# EasyEDA Pro project Project_first.eprj, schematic Schematic9 (continued)
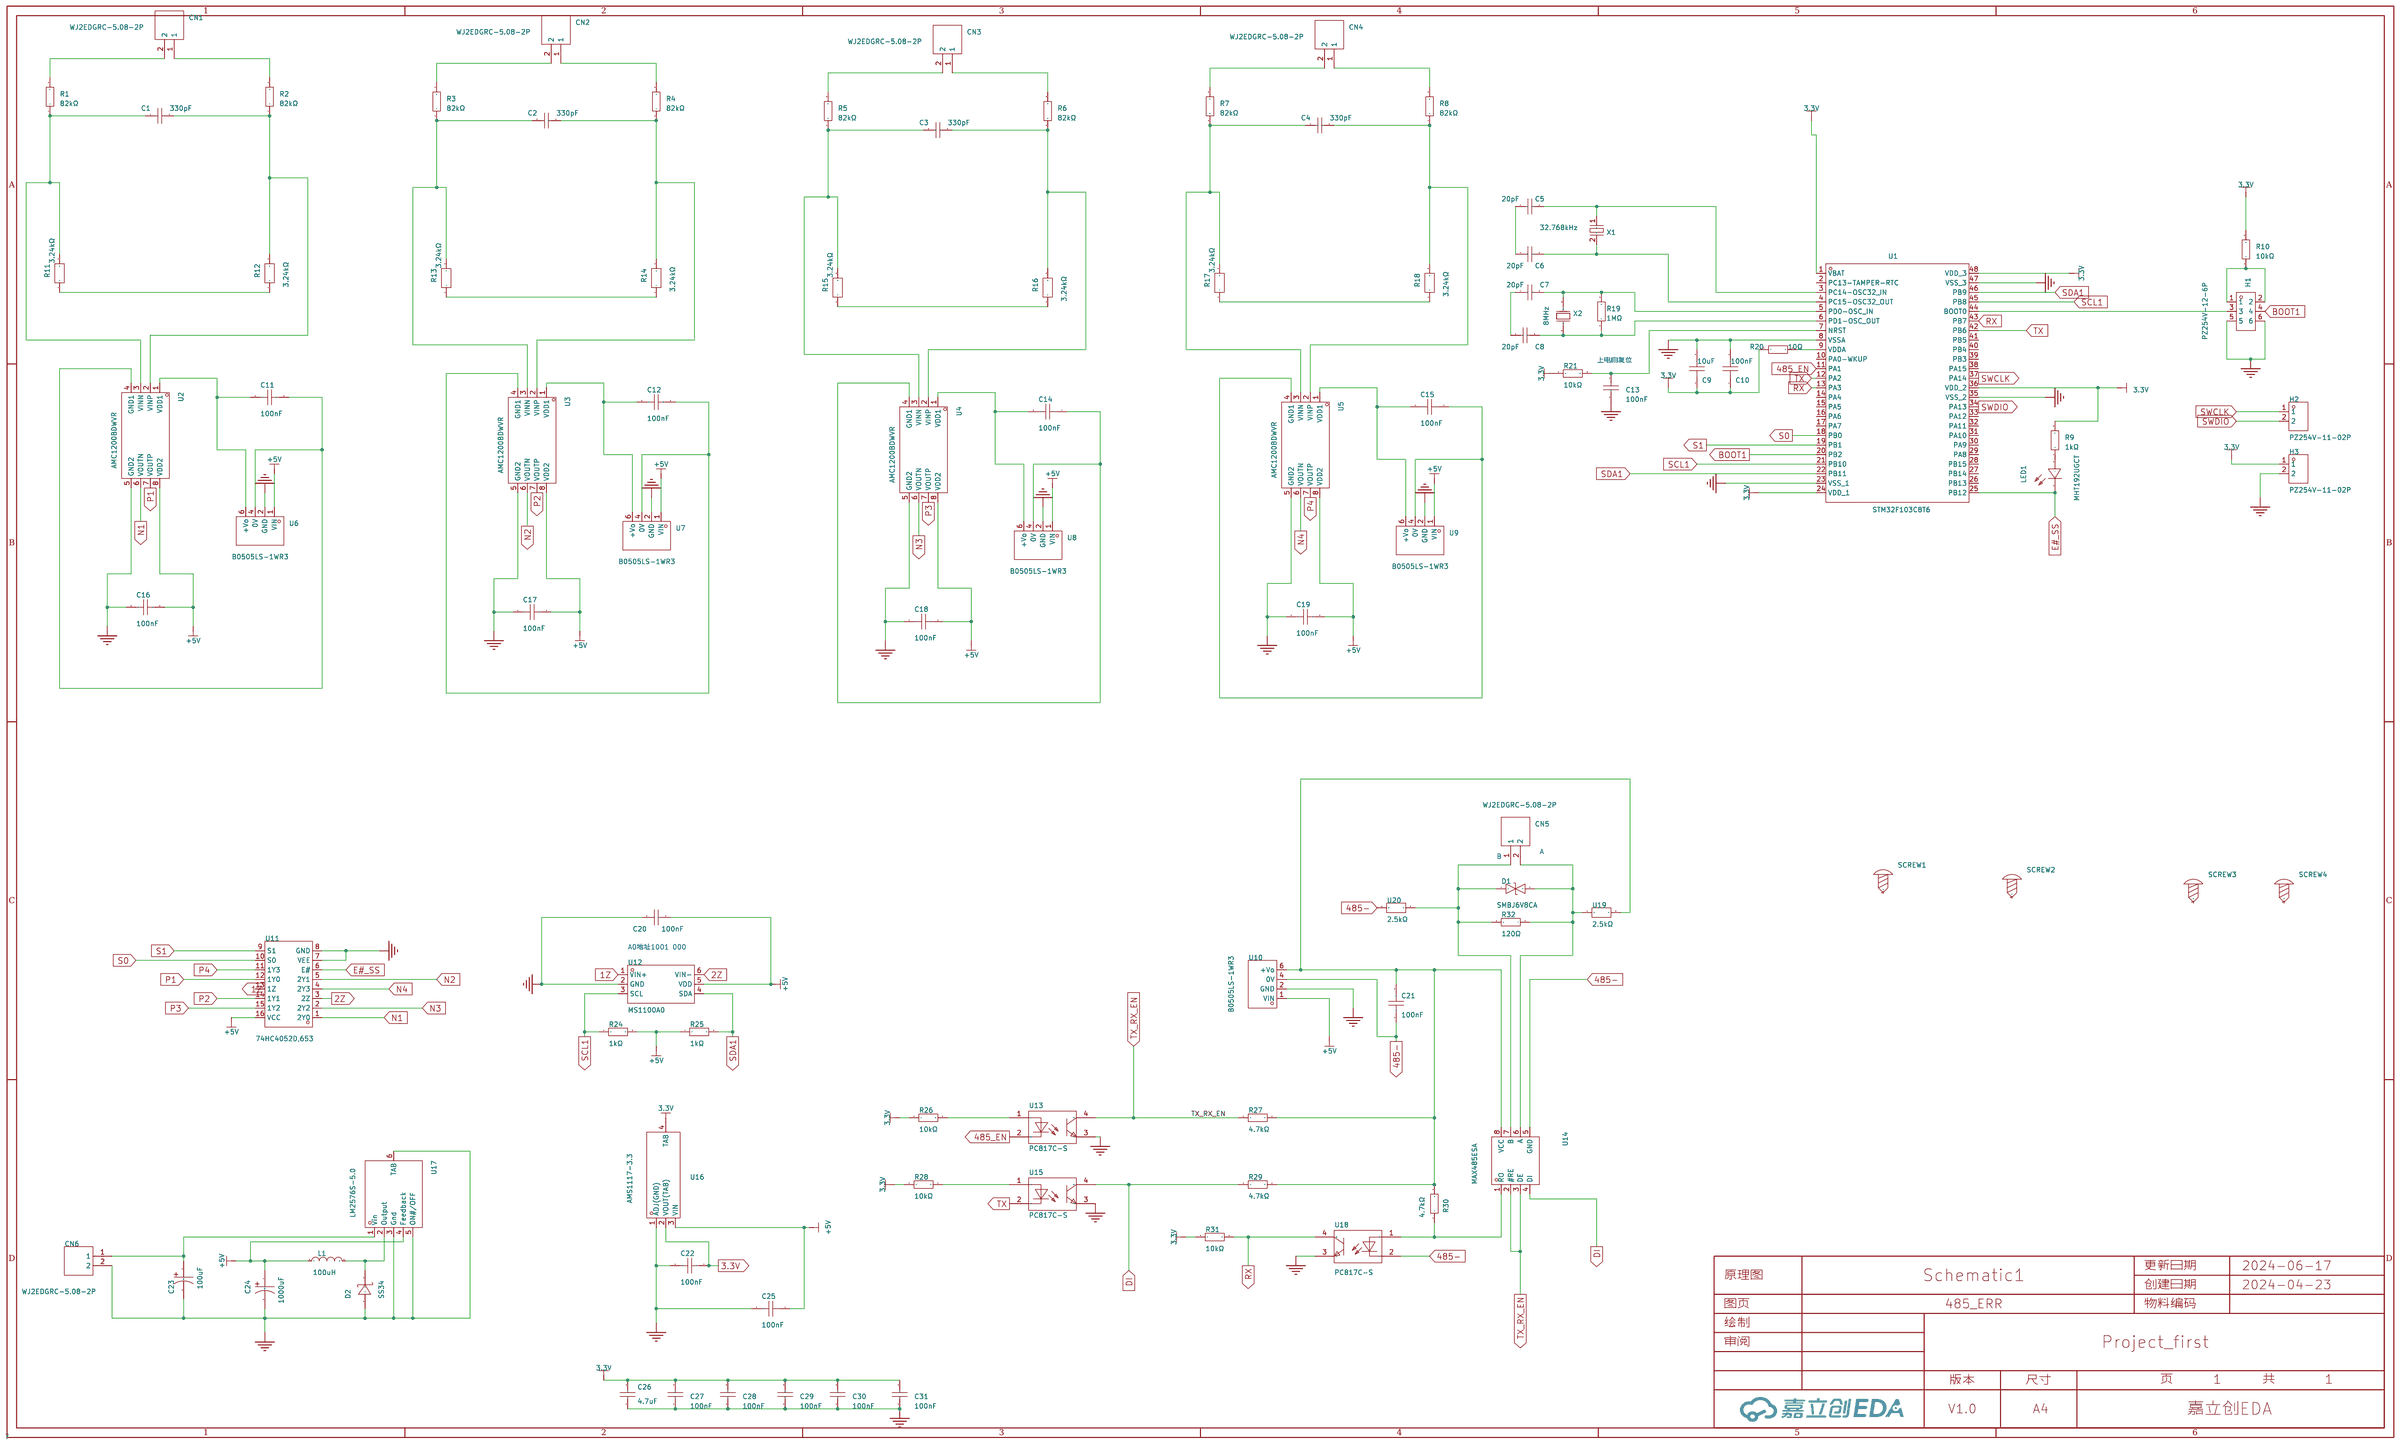
[diagram p0: schematic sheet]
## Parts (continued)
RST  PZ254V-11-02P  [HDR-TH_2P-P2.54-V-M]
SCREW1  -  [M2螺丝]
SCREW2  -  [M2螺丝]
SCREW3  -  [M2螺丝]
SCREW4  -  [M2螺丝]
SPI1  2.54-1*4P母  [HDR-TH_4P-P2.54-V-F]
STM1  STM32F103C8T6  [LQFP-48_L7.0-W7.0-P0.50-LS9.0-BL]
USART1  PZ254V-11-02P  [HDR-TH_2P-P2.54-V-M]
sheet sp232
C35  100nF  [C0603]
C36  100nF  [C0603]
C37  100nF  [C0603]
C38  100nF  [C0603]
C39  100nF  [C0603]
H1  PZ254V-12-6P  [HDR-TH_6P-P2.54-V-M-R2-C3-S2.54]
R77  120Ω  [R0603]
RS2  SP3232EEN-L/TR  [SOIC-16_L9.9-W3.9-P1.27-LS6.0-BL]
RS3  WJ500V-5.08-2P  [CONN-TH_2P-P5.00_WJ500V-5.08-2P]
sheet w5500
C10  1nF  [CAP-TH_L5.5-W4.0-P5.00-D0.5]
C11  20pF  [C0805]
C12  1nF  [CAP-TH_L5.5-W4.0-P5.00-D0.5]
C13  4.7uF  [C0603]
C14  10nF  [C0603]
C15  20pF  [C0805]
C16  22nF  [C0603]
C17  6.8nF  [C0603]
C18  6.8nF  [C0603]
C19  10nF  [C0603]
L1  HR641680E  [XFMR-SMD_HR641680E]
R7  10kΩ  [R0603]
R8  10kΩ  [R0603]
R9  12.4kΩ  [R0603]
R10  10kΩ  [R0603]
R11  10kΩ  [R0603]
R12  10kΩ  [R0603]
R13  10kΩ  [R0603]
R14  75Ω  [R0603]
R15  75Ω  [R0603]
R16  75Ω  [R0603]
R17  75Ω  [R0603]
R18  10Ω  [R0603]
R19  330Ω  [R0603]
R20  49.9Ω  [R0603]
R21  49.9Ω  [R0603]
R22  330Ω  [R0603]
R23  82Ω  [R0603]
R24  82Ω  [R0603]
RJ1  R-RJ45R08P-C000  [RJ45-TH_R-RJ45R08P-C000]
U1  FCM1608KF-201T08  [L0603]
U2  W5500  [LQFP-48_L7.0-W7.0-P0.50-LS9.0-BL]
X1  25MHz  [HC-49US_L11.5-W4.5-P4.88]
sheet 差分电压
C20  10uF  [C0603]
C21  0.1uF  [C0603]
C22  10uF  [C0603]
C23  0.1uF  [C0603]
C24  10uF  [C0603]
C25  0.1uF  [C0603]
P1  WJ500V-5.08-2P  [CONN-TH_2P-P5.00_WJ500V-5.08-2P]
P2  WJ500V-5.08-2P  [CONN-TH_2P-P5.00_WJ500V-5.08-2P]
P3  WJ500V-5.08-2P  [CONN-TH_2P-P5.00_WJ500V-5.08-2P]
P4  WJ500V-5.08-2P  [CONN-TH_2P-P5.00_WJ500V-5.08-2P]
P5  WJ500V-5.08-2P  [CONN-TH_2P-P5.00_WJ500V-5.08-2P]
P6  WJ500V-5.08-2P  [CONN-TH_2P-P5.00_WJ500V-5.08-2P]
P7  WJ500V-5.08-2P  [CONN-TH_2P-P5.00_WJ500V-5.08-2P]
P8  WJ500V-5.08-2P  [CONN-TH_2P-P5.00_WJ500V-5.08-2P]
P9  WJ500V-5.08-2P  [CONN-TH_2P-P5.00_WJ500V-5.08-2P]
P10  WJ500V-5.08-2P  [CONN-TH_2P-P5.00_WJ500V-5.08-2P]
P11  WJ500V-5.08-2P  [CONN-TH_2P-P5.00_WJ500V-5.08-2P]
P12  WJ500V-5.08-2P  [CONN-TH_2P-P5.00_WJ500V-5.08-2P]
R25  82kΩ  [R0805]
R26  82kΩ  [R0805]
R27  82kΩ  [R0805]
R28  82kΩ  [R0805]
R29  82kΩ  [R0805]
R30  82kΩ  [R0805]
R31  82kΩ  [R0805]
R32  82kΩ  [R0805]
R33  3.24kΩ  [R0805]
R34  3.24kΩ  [R0805]
R35  3.24kΩ  [R0805]
R36  3.24kΩ  [R0805]
R37  3.24kΩ  [R0805]
R38  3.24kΩ  [R0805]
R39  3.24kΩ  [R0805]
R40  3.24kΩ  [R0805]
R41  82kΩ  [R0805]
R42  82kΩ  [R0805]
R43  82kΩ  [R0805]
R44  82kΩ  [R0805]
R45  82kΩ  [R0805]
R46  82kΩ  [R0805]
R47  82kΩ  [R0805]
R48  82kΩ  [R0805]
R49  3.24kΩ  [R0805]
R50  3.24kΩ  [R0805]
R51  3.24kΩ  [R0805]
R52  3.24kΩ  [R0805]
R53  3.24kΩ  [R0805]
R54  3.24kΩ  [R0805]
R55  3.24kΩ  [R0805]
R56  3.24kΩ  [R0805]
R57  82kΩ  [R0805]
R58  82kΩ  [R0805]
R59  82kΩ  [R0805]
R60  82kΩ  [R0805]
R61  82kΩ  [R0805]
R62  82kΩ  [R0805]
R63  82kΩ  [R0805]
R64  82kΩ  [R0805]
R65  3.24kΩ  [R0805]
R66  3.24kΩ  [R0805]
R67  3.24kΩ  [R0805]
R68  3.24kΩ  [R0805]
R69  3.24kΩ  [R0805]
R70  3.24kΩ  [R0805]
R71  3.24kΩ  [R0805]
R72  3.24kΩ  [R0805]
U3  74HC4052D,653  [SOIC-16_L9.9-W3.9-P1.27-LS6.0-BL]
U4  MCP3421A0T-E/CH  [SOT-23-6_L2.9-W1.6-P0.95-LS2.8-BR]
U5  74HC4052D,653  [SOIC-16_L9.9-W3.9-P1.27-LS6.0-BL]
U6  MCP3421A0T-E/CH  [SOT-23-6_L2.9-W1.6-P0.95-LS2.8-BR]
U7  74HC4052D,653  [SOIC-16_L9.9-W3.9-P1.27-LS6.0-BL]
U8  MCP3421A0T-E/CH  [SOT-23-6_L2.9-W1.6-P0.95-LS2.8-BR]
sheet 电源
3.3  AMS1117-3.3  [SOT-223-3_L6.5-W3.5-P3.05-LS7.0]
24V1  WJ500V-5.08-2P  [CONN-TH_2P-P5.00_WJ500V-5.08-2P]
C28  100nF  [C0603]
C29  680uF  [CAP-TH_BD10.0-P5.30-D0.6-FD]
C30  100nF  [C0603]
C31  4.7uF  [C0603]
C32  220uF  [CAP-TH_BD6.3-P2.50-D1.0-FD]
C33  1000uF  [CAP-TH_BD10.0-P5.30-D0.6-FD]
D1  SS34  [SMA_L4.3-W2.6-LS5.2-RD]
D2  SS34  [SMA_L4.3-W2.6-LS5.2-RD]
D3  SS54  [SMA_L4.3-W2.6-LS5.0-FD]
L2  33uH  [IND-SMD_L3.5-W3.0]
LED3  MHT192UGCT  [LED0603-RD_GREEN]
LM2596S1  LM2596S-5.0  [TO-263-5_L10.2-W8.9-P1.70-BR]
R73  10kΩ  [R0603]

## Library data of the parts
2 = MAX485ESA_C668206: Supplier Part: C668206; Manufacturer: UMW(友台半导体); Supplier Footprint: SOP-8; JLCPCB Part Class: Extended Part; Datasheet: https://atta.szlcsc.com/upload/public/pdf/source/20231109/489730AE87B90C4B6B8CE65C07B1054C.pdf; Supplier: LCSC
24V1 485RS CAN1 P1-P12 RS3 = WJ500V-5.08-2P: 结构:1x2P;间距:5.08mm;颜色:绿色;安装方式:直插;额定电流:18A;额定电压:250V;排数:1;线规 - AWG:14~30;线规 - 平方毫米:2.5;每排PIN数:2;触头材质:-;触头镀层:-;工作温度范围:-40℃~+105℃;焊接温度(最大值):-;; LCSC Part Name: 1x2P 5.08mm 直插 排数:1 每排P数:2; Supplier Part: C8465; Manufacturer: KANGNEX(康奈克斯电气); Supplier Footprint: 插件,P=5.08mm; JLCPCB Part Class: Extended Part; Datasheet: https://atta.szlcsc.com/upload/public/pdf/source/20191225/C8465_02D34CE5B5B4A53DF5891601D97FA9F4.pdf; Supplier: LCSC; Structure: 1x2P; Pitch: 5.08mm; Color: 绿色; Mounting Style: 直插; Current Rating (Max): 18A; Voltage Rating (Max): 250V; Number of Pins: 2P; Number of Rows: 1; Wire Gauge - AWG: 14~30; Wire Gauge - mm2: 2.5; Number of PINs Per Row: 2; Operating Temperature Range: -40℃~+105℃; Screw Specification: M2.5
C16-C25 C34 C40 = CC0603KRX7R9BB104: 容值:100nF;精度:±10%;额定电压:50V;材质(温度系数):X7R;; LCSC Part Name: 100nF ±10% 50V; Supplier Part: C14663; Manufacturer: YAGEO(国巨); Supplier Footprint: 0603; JLCPCB Part Class: Basic Part; Datasheet: https://atta.szlcsc.com/upload/public/pdf/source/20180910/C282072_33301C7F631E79921B82A8DAC6BCC5B3.pdf; Supplier: LCSC; Tolerance: ±10%; Voltage Rated: 50V; Temperature Coefficient: X7R
D4 = P6SMB6.8CA/TR13: 反向截止电压(Vrwm):5.8V;最大钳位电压:10.5V;峰值脉冲电流(Ipp)@10/1000us:58.1A;峰值脉冲功率(Ppp)@10/1000us:600W;击穿电压:6.45V;; Supplier Part: C78395; Manufacturer: Brightking(君耀电子); Supplier Footprint: SMB(DO-214AA); JLCPCB Part Class: Basic Part; Datasheet: https://atta.szlcsc.com/upload/public/pdf/source/20160709/1468031879762.pdf; Supplier: LCSC; Reverse Stand-Off Voltage (Vrwm): 5.8V; Maximum Clamping Voltage: 10.5V; Peak Pulse Current (Ipp)@10/1000us: 58.1A; Peak Pulse Power Dissipation (Ppp)@10/1000us: 600W; Breakdown Voltage: 6.45V; Type: TVS
R2 R74 R76 R80 = 0805W8F1001T5E: 电阻类型:厚膜电阻;阻值:1kΩ;精度:±1%;功率:125mW;最大工作电压:150V;温度系数:±100ppm/℃;; LCSC Part Name: 1kΩ ±1% 125mW 厚膜电阻; Supplier Part: C17513; Manufacturer: UNI-ROYAL(厚声); Supplier Footprint: 0805; JLCPCB Part Class: Basic Part; Datasheet: https://atta.szlcsc.com/upload/public/pdf/source/20200306/C422600_1E6D84923E4A46A82E41ADD87F860B5C.pdf; Supplier: LCSC; Type: 厚膜电阻; Tolerance: ±1%; Power(Watts): 125mW; Overload Voltage (Max): 150V; Temperature Coefficient: ±100ppm/℃; Operating Temperature Range: -55℃~+155℃
R75 R77 R78 = 0603WAF1200T5E: 电阻类型:厚膜电阻;阻值:120Ω;精度:±1%;功率:100mW;最大工作电压:75V;温度系数:±100ppm/℃;; LCSC Part Name: 120Ω ±1% 100mW 厚膜电阻; Supplier Part: C22787; Manufacturer: UNI-ROYAL(厚声); Supplier Footprint: 0603; JLCPCB Part Class: Basic Part; Datasheet: https://atta.szlcsc.com/upload/public/pdf/source/20200306/C422600_1E6D84923E4A46A82E41ADD87F860B5C.pdf; Supplier: LCSC; Type: 厚膜电阻; Tolerance: ±1%; Power(Watts): 100mW; Overload Voltage (Max): 75V; Temperature Coefficient: ±100ppm/℃; Operating Temperature Range: -55℃~+155℃
R1 R4 R6-R8 R10-R12 R18 R20 R21 R23 R24 R73 R79 R81 = 0805W8F1002T5E_C17414: 电阻类型:厚膜电阻;阻值:10kΩ;精度:±1%;功率:125mW;最大工作电压:150V;温度系数:±100ppm/℃;; LCSC Part Name: 10kΩ ±1% 125mW 厚膜电阻; Supplier Part: C17414; Manufacturer: UNI-ROYAL(厚声); Manufacturer Part: 0805W8F1002T5E; Supplier Footprint: 0805; JLCPCB Part Class: Basic Part; Datasheet: https://atta.szlcsc.com/upload/public/pdf/source/20200306/C422600_1E6D84923E4A46A82E41ADD87F860B5C.pdf; Supplier: LCSC; Type: 厚膜电阻; Tolerance: ±1%; Power(Watts): 125mW; Overload Voltage (Max): 150V; Temperature Coefficient: ±100ppm/℃; Operating Temperature Range: -55℃~+155℃
U9 = SIT1050T: 类型:收发器;数据速率:1Mbps;; LCSC Part Name: 1Mbps 4.5V~5.5V; Supplier Part: C313021; Manufacturer: SIT(芯力特); Supplier Footprint: SO-8; JLCPCB Part Class: Extended Part; Datasheet: https://atta.szlcsc.com/upload/public/pdf/source/20190522/C313021_F295A63AE262020D1D58DBA99C3629E3.pdf; Supplier: LCSC; Type: 收发器; Data Rate: 1Mbps; Supply Voltage: 4.5V~5.5V
U10 = TJA1050T/CM,118: 类型:收发器;; LCSC Part Name: 4.75V~5.25V; Supplier Part: C6952; Manufacturer: NXP(恩智浦); Supplier Footprint: SOP-8; JLCPCB Part Class: Extended Part; Datasheet: https://atta.szlcsc.com/upload/public/pdf/source/20140411/1457707042917.pdf; Supplier: LCSC; Type: 收发器; Supply Voltage: 4.75V~5.25V; Supply Current: 50mA
8M1 X1 = TAXD8M2GLFBET2T: 晶振类型:直插晶振;频率:8MHz;常温频差:±30ppm;外接负载电容:20pF;频率稳定度(全温):±30ppm;; LCSC Part Name: 8MHz ±30ppm 20pF; Supplier Part: C107425; Manufacturer: YJX(雅晶鑫); Supplier Footprint: HC-49S; JLCPCB Part Class: Extended Part; Datasheet: https://atta.szlcsc.com/upload/public/pdf/source/20170914/C127676_1505359415156967690.pdf; Supplier: LCSC; Crystal Type: 直插晶振; Normal temperature Frequency Tolerance: ±30ppm; External load capacitor: 20pF; Frequency Stability(Full temperature range): ±30ppm; Equivalent Series Resistance (ESR): 80Ω; Operating Temperature: -20℃~+70℃
32.768k1 = Q13FC13500004_C32346: 晶振类型:贴片晶振;频率:32.768kHz;常温频差:±20ppm;外接负载电容:12.5pF;; LCSC Part Name: 32.768kHz ±20ppm 12.5pF; Supplier Part: C32346; Manufacturer: EPSON(爱普生); Manufacturer Part: Q13FC13500004; Supplier Footprint: SMD3215-2P; JLCPCB Part Class: Basic Part; Datasheet: https://atta.szlcsc.com/upload/public/pdf/source/20240418/0E0FF5F0356BA3753F616001439D1416.pdf; Supplier: LCSC; Crystal Type: 贴片晶振; Normal temperature Frequency Tolerance: ±20ppm; External load capacitor: 12.5pF; Equivalent Series Resistance (ESR): 70kΩ; Operating Temperature: -40℃~+85℃
74HSS CAN PWM2 RST USART1 = PZ254V-11-02P: 插针结构:1x2P;间距:2.54mm;行距:-;圆针/方针:方针;安装类型:直插;排数:单排;总PIN位数:2P;额定电流:-;额定电压:-;配合针长度:6mm;塑高:2.5mm;端接针长度:3mm;触头材质:黄铜;触头镀层:-;工作温度范围:-40℃~+105℃;颜色:黑色;; LCSC Part Name: 间距:2.54mm 1x2P 直插 方针; Supplier Part: C492401; Manufacturer: XFCN(兴飞); Supplier Footprint: 插件,P=2.54mm; JLCPCB Part Class: Extended Part; Datasheet: https://atta.szlcsc.com/upload/public/pdf/source/20200309/C492401_A812433581A9B211A7FFA413ADDFF0E5.pdf; Supplier: LCSC; Pin Structure: 1x2P; Pitch: 2.54mm; Circluar Pins/Square Pins: 方针; Mounting Type: 直插; Number of Rows: 单排; Number of Pins: 2P; Length of Mating Pin: 6mm; Insulation Height: 2.5mm; Length of End Connection Pin: 3mm; Contact Material: 黄铜; Operating Temperature Range: -40℃~+105℃; Color: 黑色
C1 C3 = CL21C200JBANNNC: 容值:20pF;精度:±5%;额定电压:50V;材质(温度系数):C0G;; LCSC Part Name: 20pF ±5% 50V; Supplier Part: C1798; Manufacturer: SAMSUNG(三星); Supplier Footprint: 0805; JLCPCB Part Class: Basic Part; Datasheet: https://atta.szlcsc.com/upload/public/pdf/source/20160218/1457707763339.pdf; Supplier: LCSC; Tolerance: ±5%; Voltage Rated: 50V; Temperature Coefficient: C0G
C2 C4 = CC0603CRNPO9BN9R0: 容值:9pF;额定电压:50V;材质(温度系数):NP0;; LCSC Part Name: 9pF 50V; Supplier Part: C282076; Manufacturer: YAGEO(国巨); Supplier Footprint: 0603; JLCPCB Part Class: Extended Part; Datasheet: https://atta.szlcsc.com/upload/public/pdf/source/20181008/C309499_21CC21451B82C39E3D92150FD6B30293.pdf; Supplier: LCSC; Voltage Rated: 50V; Temperature Coefficient: NP0
C5 C41 = CL31B105KBHNNNE: 容值:1uF;精度:±10%;额定电压:50V;材质(温度系数):X7R;; LCSC Part Name: 1uF ±10% 50V; Supplier Part: C1848; Manufacturer: SAMSUNG(三星); Supplier Footprint: 1206; JLCPCB Part Class: Basic Part; Datasheet: https://atta.szlcsc.com/upload/public/pdf/source/20160218/1457707763339.pdf; Supplier: LCSC; Tolerance: ±10%; Voltage Rated: 50V; Temperature Coefficient: X7R
C6-C9 C28 C30 C31 C35-C39 = CC0805KRX7R9BB104: 容值:100nF;精度:±10%;额定电压:50V;材质(温度系数):X7R;; LCSC Part Name: 100nF ±10% 50V; Supplier Part: C49678; Manufacturer: YAGEO(国巨); Supplier Footprint: 0805; JLCPCB Part Class: Basic Part; Datasheet: https://atta.szlcsc.com/upload/public/pdf/source/20180224/C181747_15194369449651363981.pdf; Supplier: LCSC; Tolerance: ±10%; Voltage Rated: 50V; Temperature Coefficient: X7R
Debug1 OLED = PZ254V-11-04P: 插针结构:1x4P;间距:2.54mm;行距:-;圆针/方针:方针;安装类型:直插;排数:单排;总PIN位数:4P;额定电流:3A;额定电压:250V;配合针长度:6mm;塑高:2.5mm;端接针长度:3mm;触头材质:-;工作温度范围:-40℃~+105℃;颜色:黑色;; LCSC Part Name: 间距:2.54mm 1x4P 直插 方针; Supplier Part: C2691448; Manufacturer: XFCN(兴飞); Supplier Footprint: 插件,P=2.54mm; JLCPCB Part Class: Extended Part; Datasheet: https://atta.szlcsc.com/upload/public/pdf/source/20200309/C492403_F9F19131791D08044AD4F84F8E751A34.pdf; Supplier: LCSC; Pin Structure: 1x4P; Pitch: 2.54mm; Circluar Pins/Square Pins: 方针; Mounting Type: 直插; Number of Rows: 单排; Number of Pins: 4P; Current Rating (Max): 3A; Voltage Rating (Max): 250V; Length of Mating Pin: 6mm; Insulation Height: 2.5mm; Length of End Connection Pin: 3mm; Operating Temperature Range: -40℃~+105℃; Color: 黑色
LED1-LED4 = MHT192UGCT: 发光颜色:翠绿色;功率:60mW;正向电流:20mA;主波长:515nm~530nm;二极管配置:-;透镜颜色:无色透明透镜;色温:-;发光角度:120°;载带方式:-;工作温度:-40℃~+85℃;; LCSC Part Name: 翠绿; Supplier Part: C389519; Manufacturer: MEIHUA(美华); Supplier Footprint: 0603; JLCPCB Part Class: Extended Part; Datasheet: https://atta.szlcsc.com/upload/public/pdf/source/20190515/C389519_7BC27E831414348C8AF19AF18EE4BF58.pdf; Supplier: LCSC; Emitted Color: 翠绿色; Power Dissipation: 60mW; Forward Current: 20mA; Dominant Wavelength: 515nm~530nm; Peak Wavelength: 518nm; Lens Color: 无色透明透镜; Viewing Angle: 120°; Operating Temperature: -40℃~+85℃
MOD_SS PWM1 = 2.54-1*3P针: 插针结构:1x3P;间距:2.54mm;行距:-;圆针/方针:方针;安装类型:直插;排数:单排;总PIN位数:3P;额定电流:3A;额定电压:-;配合针长度:-;塑高:-;端接针长度:-;触头材质:-;触头镀层:-;工作温度范围:-40℃~+105℃;颜色:黑色;; LCSC Part Name: 间距:2.54mm 1x3P 直插 方针; Supplier Part: C49257; Manufacturer: BOOMELE(博穆精密); Supplier Footprint: 插件,P=2.54mm; JLCPCB Part Class: Extended Part; Datasheet: https://atta.szlcsc.com/upload/public/pdf/source/20221018/3E9408392E35E6F57A28985E5F7BF5C9.pdf; Supplier: LCSC; Pin Structure: 1x3P; Pitch: 2.54mm; Circluar Pins/Square Pins: 方针; Mounting Type: 直插; Number of Rows: 单排; Number of Pins: 3P; Current Rating (Max): 3A; Operating Temperature Range: -40℃~+105℃; Color: 黑色
R3 R5 = 0603WAF100JT5E: 电阻类型:厚膜电阻;阻值:10Ω;精度:±1%;功率:100mW;最大工作电压:75V;温度系数:±400ppm/℃;; LCSC Part Name: 10Ω ±1% 100mW 厚膜电阻; Supplier Part: C22859; Manufacturer: UNI-ROYAL(厚声); Supplier Footprint: 0603; JLCPCB Part Class: Basic Part; Datasheet: https://atta.szlcsc.com/upload/public/pdf/source/20200306/C422600_1E6D84923E4A46A82E41ADD87F860B5C.pdf; Supplier: LCSC; Type: 厚膜电阻; Tolerance: ±1%; Power(Watts): 100mW; Overload Voltage (Max): 75V; Temperature Coefficient: ±400ppm/℃; Operating Temperature Range: -55℃~+155℃
Reset1 Reset2 = TS-1002S-04326C: 电路结构:单刀单掷;按钮形状:圆形按钮;安装方式:立贴;开关长度:6mm;开关宽度:6mm;开关高度:4.3mm;触点电流:50mA;额定电压(DC):12V;带灯:-;机械寿命:-;; LCSC Part Name: 6*6*4.3mm 立贴 轻触开关; Supplier Part: C455108; Manufacturer: XUNPU(讯普); Supplier Footprint: SMD,6x6mm; JLCPCB Part Class: Extended Part; Datasheet: https://atta.szlcsc.com/upload/public/pdf/source/20191118/C455126_F61E8FA1ED640FB1CE0B30B55DEB62E3.pdf; Supplier: LCSC; Circuit: 单刀单掷; Actuator Style: 圆形按钮; Mounting Style: 立贴; Switch Length: 6mm; Switch Width: 6mm; Switch Height: 4.3mm; Contact Current: 50mA; Voltage Rating (DC): 12V
SCREW1-SCREW4 = M2螺丝: Supplier Footprint: 插件
SPI1 = 2.54-1*4P母: 插孔结构:1x4P;间距:2.54mm;行距:-;圆孔/方孔:方孔;安装类型:直插;排数:单排;总孔位数:4P;额定电流:3A;额定电压:-;插孔方向:顶部;塑高:-;触头材质:青铜;触头镀层:-;工作温度范围:-40℃~+105℃;焊接温度(最大值):-;; LCSC Part Name: 间距:2.54mm 1x4P 直插; Supplier Part: C2718488; Manufacturer: BOOMELE(博穆精密); Supplier Footprint: 插件,P=2.54mm; JLCPCB Part Class: Extended Part; Datasheet: https://atta.szlcsc.com/upload/public/pdf/source/20210301/C2718488_F4427B881E42CAA8DDB0B1C12B3A522C.pdf; Supplier: LCSC; Holes Structure: 1x4P; Pitch: 2.54mm; Circular Hole / Square Hole: 方孔; Mounting Type: 直插; Number of Rows: 单排; Number of Holes: 4P; Current Rating (Max): 3A; Holes Direction: 顶部; Contact Material: 青铜; Operating Temperature Range: -40℃~+105℃
STM1 = STM32F103C8T6: CPU内核:CM3;程序存储容量:64KB;RAM总容量:20KB;GPIO端口数量:37;工作电压范围:2V~3.6V;CPU最大主频:72MHz;程序存储器类型:FLASH;; LCSC Part Name: STM32F103C8T6 MSL=3; Supplier Part: C8734; Manufacturer: ST(意法半导体); Supplier Footprint: LQFP-48(7x7); JLCPCB Part Class: Extended Part; Datasheet: https://atta.szlcsc.com/upload/public/pdf/source/20220812/8363ACEC51AD55ECEB84799464F7CB85.pdf; Supplier: LCSC; CPU Core: CM3; Program Storage Size: 64KB; RAM Size: 20KB; GPIO Ports Number: 37; Operating Voltage Range: 2V~3.6V; CPU Maximum Speed: 72MHz; Program Memory Type: FLASH; Operating Temperature Range: -40℃~+85℃; ADC (Bit): 12bit; Universal Serial Bus: 有; Peripheral/Function: 看门狗；DMA；看门狗；片载温度传感器; Watchdog: 有; Infrared Data Association: 有; Low-Voltage Detect: 有; Direct Memory Access: 有; Internal Oscillator: 有
H1 = PZ254V-12-6P: 插针结构:2x3P;间距:2.54mm;行距:2.54mm;圆针/方针:方针;安装类型:直插;排数:双排;总PIN位数:6P;额定电流:-;额定电压:-;配合针长度:6mm;塑高:2.5mm;端接针长度:3mm;触头材质:黄铜;触头镀层:-;工作温度范围:-40℃~+105℃;颜色:黑色;; LCSC Part Name: 间距:2.54mm 2x3P 直插 方针; Supplier Part: C492420; Manufacturer: XFCN(兴飞); Supplier Footprint: 插件,P=2.54mm; JLCPCB Part Class: Extended Part; Datasheet: https://atta.szlcsc.com/upload/public/pdf/source/20200309/C492420_BAECB307B001054C09D200388220EAE6.pdf; Supplier: LCSC; Pin Structure: 2x3P; Pitch: 2.54mm; Row Spacing: 2.54mm; Circluar Pins/Square Pins: 方针; Mounting Type: 直插; Number of Rows: 双排; Number of Pins: 6P; Length of Mating Pin: 6mm; Insulation Height: 2.5mm; Length of End Connection Pin: 3mm; Contact Material: 黄铜; Operating Temperature Range: -40℃~+105℃; Color: 黑色
RS2 = SP3232EEN-L/TR: 类型:收发器;驱动器/接收器:2/2;数据速率:235Kbps;; LCSC Part Name: 3.0V至5.5V RS-232收发器; Supplier Part: C9378; Manufacturer: MaxLinear(迈凌); Supplier Footprint: SOIC-16; JLCPCB Part Class: Extended Part; Datasheet: https://atta.szlcsc.com/upload/public/pdf/source/20201223/C9378_07B7140F492E50475A665D5A3819EE11.pdf; Supplier: LCSC; Types: 收发器; Driver/receiver: 2/2; Data Rate: 235Kbps; Supply Voltage: 3V~5.5V; Operating Temperature: -40℃~+85℃
C10 C12 = Y5P102K2KV16CC0224: 容值:1nF;精度:±10%;额定电压:2kV;温度系数:SL;; LCSC Part Name: 1nF ±10% 2kV; Supplier Part: C2887266; Manufacturer: KNSCHA(科尼盛); Supplier Footprint: 插件,P=5mm; JLCPCB Part Class: Extended Part; Datasheet: https://atta.szlcsc.com/upload/public/pdf/source/20210824/9DB7111BBFCE5397BE2F54950262B877.pdf; Supplier: LCSC; Tolerance: ±10%; Voltage Rated: 2kV; Lead Spacing: 5mm; Temperature Coefficient: SL
C11 C15 = CC0603JRNPO9BN200: 容值:20pF;精度:±5%;额定电压:50V;材质(温度系数):NP0;; LCSC Part Name: 20pF ±5% 50V; Supplier Part: C105621; Manufacturer: YAGEO(国巨); Supplier Footprint: 0603; JLCPCB Part Class: Extended Part; Datasheet: https://atta.szlcsc.com/upload/public/pdf/source/20170505/1493957838062.pdf; Supplier: LCSC; Tolerance: ±5%; Voltage Rated: 50V; Temperature Coefficient: NP0
C13 = CL10A475KO8NNNC: 容值:4.7uF;精度:±10%;额定电压:16V;材质(温度系数):X5R;; LCSC Part Name: 4.7uF ±10% 16V; Supplier Part: C19666; Manufacturer: SAMSUNG(三星); Supplier Footprint: 0603; JLCPCB Part Class: Basic Part; Datasheet: https://atta.szlcsc.com/upload/public/pdf/source/20160218/1457707763339.pdf; Supplier: LCSC; Tolerance: ±10%; Voltage Rated: 16V; Temperature Coefficient: X5R
C14 = CL10A106KP8NNNC: 容值:10uF;精度:±10%;额定电压:10V;材质(温度系数):X5R;; LCSC Part Name: 10uF ±10% 10V; Supplier Part: C19702; Manufacturer: SAMSUNG(三星); Supplier Footprint: 0603; JLCPCB Part Class: Basic Part; Datasheet: https://atta.szlcsc.com/upload/public/pdf/source/20160218/1457707763339.pdf; Supplier: LCSC; Tolerance: ±10%; Voltage Rated: 10V; Temperature Coefficient: X5R
L1 = HR641680E: 线匝比:1:1;; Supplier Part: C189555; Manufacturer: HANRUN(汉仁); Supplier Footprint: SMD; JLCPCB Part Class: Extended Part; Datasheet: https://atta.szlcsc.com/upload/public/pdf/source/20180504/C189555_B2A024E12FD3468D1F5D0CA7444B84A6.pdf; Supplier: LCSC; Turns Ratio: 1:1
R9 R14-R17 R19 R22 = FRC1206F3241TS: 电阻类型:厚膜电阻;阻值:3.24kΩ;精度:±1%;功率:250mW;最大工作电压:200V;温度系数:±100ppm/℃;; LCSC Part Name: 3.24kΩ ±1% 250mW 厚膜电阻; Supplier Part: C5153989; Manufacturer: FOJAN(富捷); Supplier Footprint: 1206; JLCPCB Part Class: Extended Part; Datasheet: https://atta.szlcsc.com/upload/public/pdf/source/20211221/925EC7D7225764EE0046F22065062C87.pdf; Supplier: LCSC; Type: 厚膜电阻; Tolerance: ±1%; Power(Watts): 250mW; Overload Voltage (Max): 200V; Temperature Coefficient: ±100ppm/℃
R13 = 0603WAF4701T5E: 电阻类型:厚膜电阻;阻值:4.7kΩ;精度:±1%;功率:100mW;最大工作电压:75V;温度系数:±100ppm/℃;; LCSC Part Name: 4.7kΩ ±1% 100mW 厚膜电阻; Supplier Part: C23162; Manufacturer: UNI-ROYAL(厚声); Supplier Footprint: 0603; JLCPCB Part Class: Basic Part; Datasheet: https://atta.szlcsc.com/upload/public/pdf/source/20200306/C422600_1E6D84923E4A46A82E41ADD87F860B5C.pdf; Supplier: LCSC; Type: 厚膜电阻; Tolerance: ±1%; Power(Watts): 100mW; Overload Voltage (Max): 75V; Temperature Coefficient: ±100ppm/℃; Operating Temperature Range: -55℃~+155℃
RJ1 = R-RJ45R08P-C000: 连接器类型:RJ45插座;端口数量:1;安装方式:弯插;屏蔽:有屏蔽;LED:带LED;等级:-;触头材质:-;触头镀层:-;工作温度范围:0℃~+70℃;焊接温度(最大值):-;; LCSC Part Name: 弯插 带LED; Supplier Part: C386757; Manufacturer: Ckmtw(灿科盟); Supplier Footprint: 插件; JLCPCB Part Class: Extended Part; Datasheet: https://atta.szlcsc.com/upload/public/pdf/source/20190508/C386757_590BCC8A33AAEEF7838490D656B2E4CF.pdf; Supplier: LCSC; Connector Type: RJ45插座; Number of Ports: 1; Mounting Style: 弯插; Shielding: 有屏蔽; LED: 带LED; Operating Temperature Range: 0℃~+70℃; Supplementary Features: 鱼叉脚(塑料)
U1 = FCM1608KF-201T08: Supplier Part: C17701323; Manufacturer: TAI-TECH(台庆); Supplier Footprint: 1608; JLCPCB Part Class: Extended Part; Datasheet: https://atta.szlcsc.com/upload/public/pdf/source/20230912/98C664CB35A59A909125601204A227D4.pdf; Supplier: LCSC
U2 = W5500: Hardwired TCP/IP embedded Ethernet controller that provides easier Internet connection to embedded systems; LCSC Part Name: 硬连线TCP/IP嵌入式以太网控制器; Supplier Part: C32843; Manufacturer: WIZNET; Supplier Footprint: LQFP-48(7x7); Datasheet: https://atta.szlcsc.com/upload/public/pdf/source/20230714/E10C32B058E0BA54FCE1C1556BE10C07.pdf; Supplier: LCSC
R25-R32 R41-R48 R57-R64 = 1206W4F8202T5E: 电阻类型:厚膜电阻;阻值:82kΩ;精度:±1%;功率:250mW;最大工作电压:200V;温度系数:±100ppm/℃;; LCSC Part Name: 82kΩ ±1% 250mW 厚膜电阻; Supplier Part: C17979; Manufacturer: UNI-ROYAL(厚声); Supplier Footprint: 1206; JLCPCB Part Class: Extended Part; Datasheet: https://atta.szlcsc.com/upload/public/pdf/source/20200306/C422600_1E6D84923E4A46A82E41ADD87F860B5C.pdf; Supplier: LCSC; Type: 厚膜电阻; Tolerance: ±1%; Power(Watts): 250mW; Overload Voltage (Max): 200V; Temperature Coefficient: ±100ppm/℃; Operating Temperature Range: -55℃~+155℃; Check: true
R33-R40 R49-R56 R65-R72 = FRC1206F3241TS: 电阻类型:厚膜电阻;阻值:3.24kΩ;精度:±1%;功率:250mW;最大工作电压:200V;温度系数:±100ppm/℃;; LCSC Part Name: 3.24kΩ ±1% 250mW 厚膜电阻; Supplier Part: C5153989; Manufacturer: FOJAN(富捷); Supplier Footprint: 1206; JLCPCB Part Class: Extended Part; Datasheet: https://atta.szlcsc.com/upload/public/pdf/source/20211221/925EC7D7225764EE0046F22065062C87.pdf; Supplier: LCSC; Type: 厚膜电阻; Tolerance: ±1%; Power(Watts): 250mW; Overload Voltage (Max): 200V; Temperature Coefficient: ±100ppm/℃; Check: true
U3 U5 U7 = 74HC4052D,653: 开关电路:单刀四掷(SP4T);通道数:2;导通电阻(Ron@VCC):150Ω;; LCSC Part Name: 双4通道模拟复用器 解复用器; Supplier Part: C11350; Manufacturer: Nexperia(安世); Supplier Footprint: SOIC-16; JLCPCB Part Class: Extended Part; Datasheet: https://atta.szlcsc.com/upload/public/pdf/source/20130225/1457706594415.pdf; Supplier: LCSC; Switch Circuit: 单刀四掷(SP4T); Number of Channels: 2; Supply Voltage: 2V~10V; Turn-on time: 58ns; On-State Resistance (Max): 150Ω; Turn-off time: 48ns
U4 U6 U8 = MCP3421A0T-E/CH: 接口:I2C;电源电压:2.7V~5.5V;采样率:3.75Hz;分辨率:18位;; Supplier Part: C29454; Manufacturer: MICROCHIP(美国微芯); Supplier Footprint: SOT-23-6; JLCPCB Part Class: Extended Part; Datasheet: https://atta.szlcsc.com/upload/public/pdf/source/20140403/1457707041712.pdf; Supplier: LCSC; Interface: I2C; differential input: 是; number of channels: 1; Supply Voltage: 2.7V~5.5V; sampling frequency: 3.75Hz; resolution: 18位; Operating Temperature: -40℃~+125℃
3.3 = AMS1117-3.3_C5250992: 输出类型：固定 输出极性：正 最大输入电压：18V 输出电压：3.3V 输出电流：1A 电源纹波抑制比(PSRR)：60dB@(120Hz)。当前应用较多领域：三端稳压器，机顶盒; Supplier Part: C5250992; Manufacturer: TWGMC(台湾迪嘉); Supplier Footprint: SOT-223-3L; JLCPCB Part Class: Extended Part; Datasheet: https://atta.szlcsc.com/upload/public/pdf/source/20221109/A58A92B07670E85D28928AE371260E8D.pdf; Supplier: LCSC
C29 = ERS1HM681W20OT: 容值:680uF;精度:±20%;额定电压:50V;; LCSC Part Name: 680uF ±20% 50V; Supplier Part: C106668; Manufacturer: AISHI(艾华集团); Supplier Footprint: 插件,D12.5xL20mm; JLCPCB Part Class: Extended Part; Datasheet: https://atta.szlcsc.com/upload/public/pdf/source/20191015/C438940_4B8E60A742BB0AE40DDEF87A5C89089D.pdf; Supplier: LCSC; Tolerance: ±20%; Rated Voltage: 50V; Lead Spacing: 5mm; φD: 12.5mm; L: 20mm; Lifetime @ Temp: 10000hrs@105℃
C32 C33 = GR227M025E12RR0VH4FP0: 容值:220uF;精度:±20%;额定电压:25V;纹波电流:-;等效串联电阻:-;; LCSC Part Name: 220uF ±20% 25V 黑; Supplier Part: C43838; Manufacturer: CX(承兴); Supplier Footprint: 插件,D6.3xL12mm; JLCPCB Part Class: Extended Part; Datasheet: https://atta.szlcsc.com/upload/public/pdf/source/20211027/ED0DA65C69F42D9BDEC91091BA4C03CD.pdf; Supplier: LCSC; Tolerance: ±20%; Rated Voltage: 25V; Lead Spacing: 2.5mm; φD: 6.3mm; L: 12mm; Lifetime @ Temp: 2000hrs@105℃; Operating Temperature: -40℃~+105℃
D1 D2 = SS34_C8678: 二极管配置:独立式;正向压降(Vf):550mV@3A;直流反向耐压(Vr):40V;平均整流电流(Io):3A;; LCSC Part Name: 电压:40V 电流:3A; Supplier Part: C8678; Manufacturer: MDD; Supplier Footprint: SMA(DO-214AC); JLCPCB Part Class: Basic Part; Datasheet: https://atta.szlcsc.com/upload/public/pdf/source/20230314/A80AE34493C69B89E2F4B1712F433538.pdf; Supplier: LCSC; Diode Configuration: 独立式; Forward Voltage (Vf@If): 550mV@3A; Reverse Voltage (Vr): 40V; Average Rectified Current (Io): 3A; Reverse Leakage Current (Ir): 500uA@40V
D3 = SS54_C7420369: 二极管配置:独立式;正向压降(Vf):550mV@5.0A;直流反向耐压(Vr):40V;平均整流电流(Io):5A;; LCSC Part Name: 电压:40V 电流:5A; Supplier Part: C7420369; Manufacturer: 宏迦橙; Supplier Footprint: SMA(DO-214AC); JLCPCB Part Class: Extended Part; Datasheet: https://atta.szlcsc.com/upload/public/pdf/source/20230828/254C3882F8647358AD9F60DD73611B5E.pdf; Supplier: LCSC; Diode Configuration: 独立式; Forward Voltage (Vf@If): 550mV@5.0A; Reverse Voltage (Vr): 40V; Average Rectified Current (Io): 5A; Reverse Leakage Current (Ir): 50uA@40V; Peak forward surge current: 120A
L2 = CD32YP0302-330M: 电感值:33uH;精度:±20%;额定电流:600mA;; LCSC Part Name: 33uH ±20%; Supplier Part: C492262; Manufacturer: YJYCOIN(益嘉源); Supplier Footprint: SMD,3.5x3x2.1mm; JLCPCB Part Class: Extended Part; Datasheet: https://atta.szlcsc.com/upload/public/pdf/source/20200311/C492266_3C4DCA97B8B94D4CA8DBD234C7C1D8A4.pdf; Supplier: LCSC; Tolerance: ±20%; Rated Current: 600mA; DC Resistance (DCR): 951mΩ
LM2596S1 = LM2596S-5.0_C347421: 功能类型:降压型;输出类型:固定;输入电压:40V;输出电压:5V;输出电流(最大值):3A;; Supplier Part: C347421; Manufacturer: UMW(友台半导体); Supplier Footprint: TO-263-5; JLCPCB Part Class: Extended Part; Datasheet: https://atta.szlcsc.com/upload/public/pdf/source/20230506/0930E65C3A8B7B120C8A4D8E5A8AC327.pdf; Supplier: LCSC; Function: 降压型; Output Type: 固定; Input Voltage: 40V; Output Voltage: 5V; Output Current (Max): 3A; Switching Frequency: 150kHz; Operating Temperature: -40℃~+125℃@(TA); Synchronous Rectification: 否; Number of Outputs: 1; Topology: 降压式; Switch tube (built-in/external): 内置

## Nets
1.2V: PWM1.2 STM1.11(PA1) U2.18(VBG)
3.3V: 3.3.2(VOUT) 3.3.4(TAB) C6.2 C7.2 C8.2 C9.1 C30.1 C31.1 C35.2 Debug1.4 OLED.3 R1.2 R2.1 R73.1 R81.2 RJ1.9(L+) RJ1.11(R+) RS2.16(VCC) STM1.1(VBAT) STM1.9(VDDA) STM1.24(VDD_1) STM1.36(VDD_2) STM1.48(VDD_3) U1.1 U2.28(VDD)
3.3VA: R18.2 R20.2 R21.2 U1.2 U2.4(AVDD) U2.8(AVDD) U2.11(AVDD) U2.15(AVDD) U2.17(AVDD) U2.21(AVDD)
+5V: 2.8(VCC) C20.2 C21.2 C22.2 C23.2 C24.2 C25.2 C32.1 C33.1 C34.1 C40.1 D1.2(A) L2.2 LM2596S1.4(FB) R3.2 R5.1 R76.1 R80.1 U3.16(VCC) U4.5(VDD) U5.16(VCC) U6.5(VDD) U7.16(VCC) U8.5(VDD) U9.3(VCC)
GND: 2.5(GND) 3.3.1(GND) 24V1.2 C1.1 C2.2 C3.1 C4.2 C5.2 C6.1 C7.1 C8.1 C9.2 C10.1 C11.2 C13.1 C14.1 C15.2 C16.2 C19.1 C20.1 C21.1 C22.1 C23.1 C24.1 C25.1 C28.1 C29.2 C30.2 C31.2 C32.2 C33.2 C34.2 C35.1 C37.2 C39.2 C40.2 C41.2 D3.1(A) Debug1.3 LED3.1(-) LED4.1(-) LM2596S1.3(GND) LM2596S1.5(ON#/OFF) LM2596S1.6(EP) OLED.4 R4.2 R6.1 R7.2 R8.2 R9.1 R10.2 R11.2 R12.2 R13.1 R74.2 R77.2 R79.2 Reset1.1 Reset1.2 Reset2.1 Reset2.2 STM1.8(VSSA) STM1.23(VSS_1) STM1.35(VSS_2) STM1.47(VSS_3) U2.3(AGND) U2.9(AGND) U2.14(AGND) U2.16(AGND) U2.19(AGND) U2.29(GND) U2.48(AGND) U3.6(E#) U3.7(VEE) U3.8(GND) U4.2(VSS) U5.6(E#) U5.7(VEE) U5.8(GND) U6.2(VSS) U7.6(E#) U7.7(VEE) U7.8(GND) U8.2(VSS) U9.2(GND)
PGND: C10.2 C12.2 RJ1.13(S) RJ1.14(S)
1N0: R32.1 R40.1 U3.1(2Y0)
1N1: R26.1 R34.1 U3.5(2Y1)
1N2: R28.1 R36.1 U3.2(2Y2)
1N3: R30.1 R38.1 U3.4(2Y3)
1P0: R31.1 R39.2 U3.12(1Y0)
1P1: R25.1 R33.2 U3.14(1Y1)
1P2: R27.1 R35.2 U3.15(1Y2)
1P3: R29.1 R37.2 U3.11(1Y3)
1ZN: U3.3(2Z) U4.6(Vin-)
1ZP: U3.13(1Z) U4.1(Vin+)
2N0: R48.1 R56.1 U5.1(2Y0)
2N1: R42.1 R50.1 U5.5(2Y1)
2N2: R44.1 R52.1 U5.2(2Y2)
2N3: R46.1 R54.1 U5.4(2Y3)
2P0: R47.1 R55.2 U5.12(1Y0)
2P1: R41.1 R49.2 U5.14(1Y1)
2P2: R43.1 R51.2 U5.15(1Y2)
2P3: R45.1 R53.2 U5.11(1Y3)
2ZN: U5.3(2Z) U6.6(Vin-)
2ZP: U5.13(1Z) U6.1(Vin+)
3N0: R64.1 R72.1 U7.1(2Y0)
3N1: R58.1 R66.1 U7.5(2Y1)
3N2: R60.1 R68.1 U7.2(2Y2)
3N3: R62.1 R70.1 U7.4(2Y3)
3P0: R63.1 R71.2 U7.12(1Y0)
3P1: R57.1 R65.2 U7.14(1Y1)
3P2: R59.1 R67.2 U7.15(1Y2)
3P3: R61.1 R69.2 U7.11(1Y3)
3ZN: U7.3(2Z) U8.6(Vin-)
3ZP: U7.13(1Z) U8.1(Vin+)
232IN: RS2.8(R2IN) RS2.13(R1IN) RS3.1
232OUT: RS2.7(T2OUT) RS2.14(T1OUT) RS3.2
ACTLED: R19.2 U2.27(ACTLED)
CAN_RX: CAN.1 STM1.45(PB8) U9.4(RXD)
CAN_TX: CAN.2 STM1.46(PB9) U9.1(TXD)
CLKIN: C15.1 U2.30(XI/CLKIN) X1.1(OSC1)
D+: STM1.33(PA12)
D-: STM1.32(PA11)
EXTIO: PWM1.3 STM1.10(PA0-WKUP)
INTn: RST.1 STM1.18(PB0) U2.36(INTn)
LINKLED: R22.1 U2.25(LINKLED)
MISO1: SPI1.3 STM1.16(PA6) U2.34(MISO)
MOSI1: SPI1.4 STM1.17(PA7) U2.35(MOSI)
NET63: R14.1 RJ1.7 RJ1.8
NET64: R15.1 RJ1.4 RJ1.5
NET65: C19.2 L1.7 R23.1 R24.1
NRST: C5.1 C41.1 LED1.2(+) LED4.2(+) R1.1 R81.1 Reset2.4 STM1.7(NRST)
NSS1: SPI1.1 STM1.14(PA4) U2.32(SCSn)
OSC32_IN: 32.768k1.2 C2.1 STM1.3(PC14-OSC32_IN)
OSC32_OUT: 32.768k1.1 C4.1 STM1.4(PC15-OSC32_OUT)
OSC_IN: 8M1.1(OSC1) C3.2 STM1.5(PD0-OSC_IN)
OSC_OUT: 8M1.2(OSC2) C1.2 STM1.6(PD1-OSC_OUT)
PMOD0: MOD_SS.3 STM1.25(PB12) U2.45(PMODE0)
PMOD1: MOD_SS.2 STM1.26(PB13) U2.44(PMODE1)
PMOD2: MOD_SS.1 STM1.27(PB14) U2.43(PMODE2)
PWM1: PWM1.1 STM1.29(PA8)
PWM21: PWM2.2 STM1.39(PB3)
PWM22: PWM2.1 STM1.38(PA15)
RO: H1.1 H1.2 RS2.9(R2OUT) RS2.12(R1OUT)
RSTn: RST.2 STM1.19(PB1) U2.37(RSTn)
RX1: 2.1(RO) STM1.31(PA10) USART1.2
RX2: H1.3 STM1.13(PA3)
RX+: C18.2 L1.11
RX-: C17.2 L1.9
RXN: L1.8 U2.5(RXN)
RXP: L1.6 U2.6(RXP)
S0: 74HSS.1 STM1.40(PB4) U3.10(S0) U5.10(S0) U7.10(S0)
S1: 74HSS.2 STM1.41(PB5) U3.9(S1) U5.9(S1) U7.9(S1)
SCK1: SPI1.2 STM1.15(PA5) U2.33(SCLK)
SCL1: R5.2 STM1.42(PB6) U4.3(SCL) U6.3(SCL) U8.3(SCL)
SCL2: OLED.2 STM1.21(PB10)
SDA1: R3.1 STM1.43(PB7) U4.4(SDA) U6.4(SDA) U8.4(SDA)
SDA2: OLED.1 STM1.22(PB11)
SS_485: 2.2(#RE) 2.3(DE) STM1.28(PB15)
SWCLK: Debug1.1 STM1.37(PA14)
SWDIO: Debug1.2 STM1.34(PA13)
TIN: H1.5 H1.6 RS2.10(T2IN) RS2.11(T1IN)
TX1: 2.4(DI) STM1.30(PA9) USART1.1
TX2: H1.4 STM1.12(PA2)
TX+: L1.16 R21.1 RJ1.3
TX-: L1.14 R20.1 RJ1.6
TXN: L1.3 U2.1(TXN)
TXP: L1.1 U2.2(TXP)
XO: C11.1 U2.31(XO) X1.2(OSC2)
$1N1305: R6.2 STM1.20(PB2)
$1N1319: R4.1 STM1.44(BOOT0)
$1N29109: LED1.1(-) Reset1.4
$1N29308: LED2.1(-) STM1.2(PC13-TAMPER-RTC)
$1N29406: LED2.2(+) R2.2
$2N2210: C12.1 R14.2 R15.2 R16.2 R17.2
$2N2226: R19.1 RJ1.12(R-)
$2N2228: R22.2 RJ1.10(L-)
$2N2250: L1.10 R17.1
$2N2253: L1.15 R16.1
$2N2265: C16.1 L1.2 R18.1
$2N2271: C17.1 R23.2 RJ1.2
$2N2277: C18.1 R24.2 RJ1.1
$3N3711: R33.1 R34.2
$3N3714: P1.1 R25.2
$3N3715: P1.2 R26.2
$3N3738: R35.1 R36.2
$3N3741: P2.1 R27.2
$3N3742: P2.2 R28.2
$3N3743: R37.1 R38.2
$3N3746: P3.1 R29.2
$3N3747: P3.2 R30.2
$3N3748: R39.1 R40.2
$3N3751: P4.1 R31.2
$3N3752: P4.2 R32.2
$3N3764: P9.2 R58.2
$3N3765: P9.1 R57.2
$3N3768: R65.1 R66.2
$3N3769: P10.2 R60.2
$3N3770: P10.1 R59.2
$3N3773: R67.1 R68.2
$3N3774: P11.2 R62.2
$3N3775: P11.1 R61.2
$3N3778: R69.1 R70.2
$3N3779: P12.2 R64.2
$3N3780: P12.1 R63.2
$3N3783: R71.1 R72.2
$3N3784: P5.2 R42.2
$3N3785: P5.1 R41.2
$3N3788: R49.1 R50.2
$3N3789: P6.2 R44.2
$3N3790: P6.1 R43.2
$3N3793: R51.1 R52.2
$3N3794: P7.2 R46.2
$3N3795: P7.1 R45.2
$3N3798: R53.1 R54.2
$3N3799: P8.2 R48.2
$3N3800: P8.1 R47.2
$3N3803: R55.1 R56.2
$4N752: LED3.2(+) R73.2
$4N754: 3.3.3(VIN) C28.2 D1.1(K)
$5N1008: 2.7(B) 485RS.2 D4.2 R74.1 R75.2
$5N1009: 2.6(A) 485RS.1 D4.1 R75.1 R76.2
$6N608: C37.1 RS2.2(V+)
$6N609: C39.1 RS2.6(V-)
$6N610: C36.2 RS2.1(C1+)
$6N611: C36.1 RS2.3(C1-)
$6N612: C38.2 RS2.4(C2+)
$6N613: C38.1 RS2.5(C2-)
$6N618: R77.1 RS2.15(GND)
$7N337: R79.1 U9.8(S)
$7N341: R80.2 U9.5(Vref)
$7N343: CAN1.2 R78.2 U9.7(CANH)
$7N344: CAN1.1 R78.1 U9.6(CANL)
Net-(24V1-1): 24V1.1 D2.2(A)
Net-(C13-2): C13.2 U2.20(TOCAP)
Net-(C14-2): C14.2 U2.22(1V2O)
Net-(C29-1): C29.1 D2.1(K) LM2596S1.1(VIN)
Net-(D3-2): D3.2(K) L2.1 LM2596S1.2(OUT)
Net-(R7-1): R7.1 U2.41(RSVD)
Net-(R8-1): R8.1 U2.42(RSVD)
Net-(R9-2): R9.2 U2.10(EXRES1)
Net-(R10-1): R10.1 U2.39(RSVD)
Net-(R11-1): R11.1 U2.40(RSVD)
Net-(R12-1): R12.1 U2.38(RSVD)
Net-(R13-2): R13.2 U2.23(RSVD)

Not connected (* = marked no-connect by the designer): L1 4* 5* 12* 13*; Reset1 3*; Reset2 3; SCREW1 1; SCREW2 1; SCREW3 1; SCREW4 1; U2 7(DNC)* 12(NC)* 13(NC)* 24(SPDLED)* 26(DUPLED)* 46(NC)* 47(NC)*; U10 1(TXD) 2(GND) 3(VCC) 4(RXD) 5(VREF) 6(CANL) 7(CANH) 8(S)
